# Altium schematic sheet GenPulseBox.SchDoc (part 2 of 2)
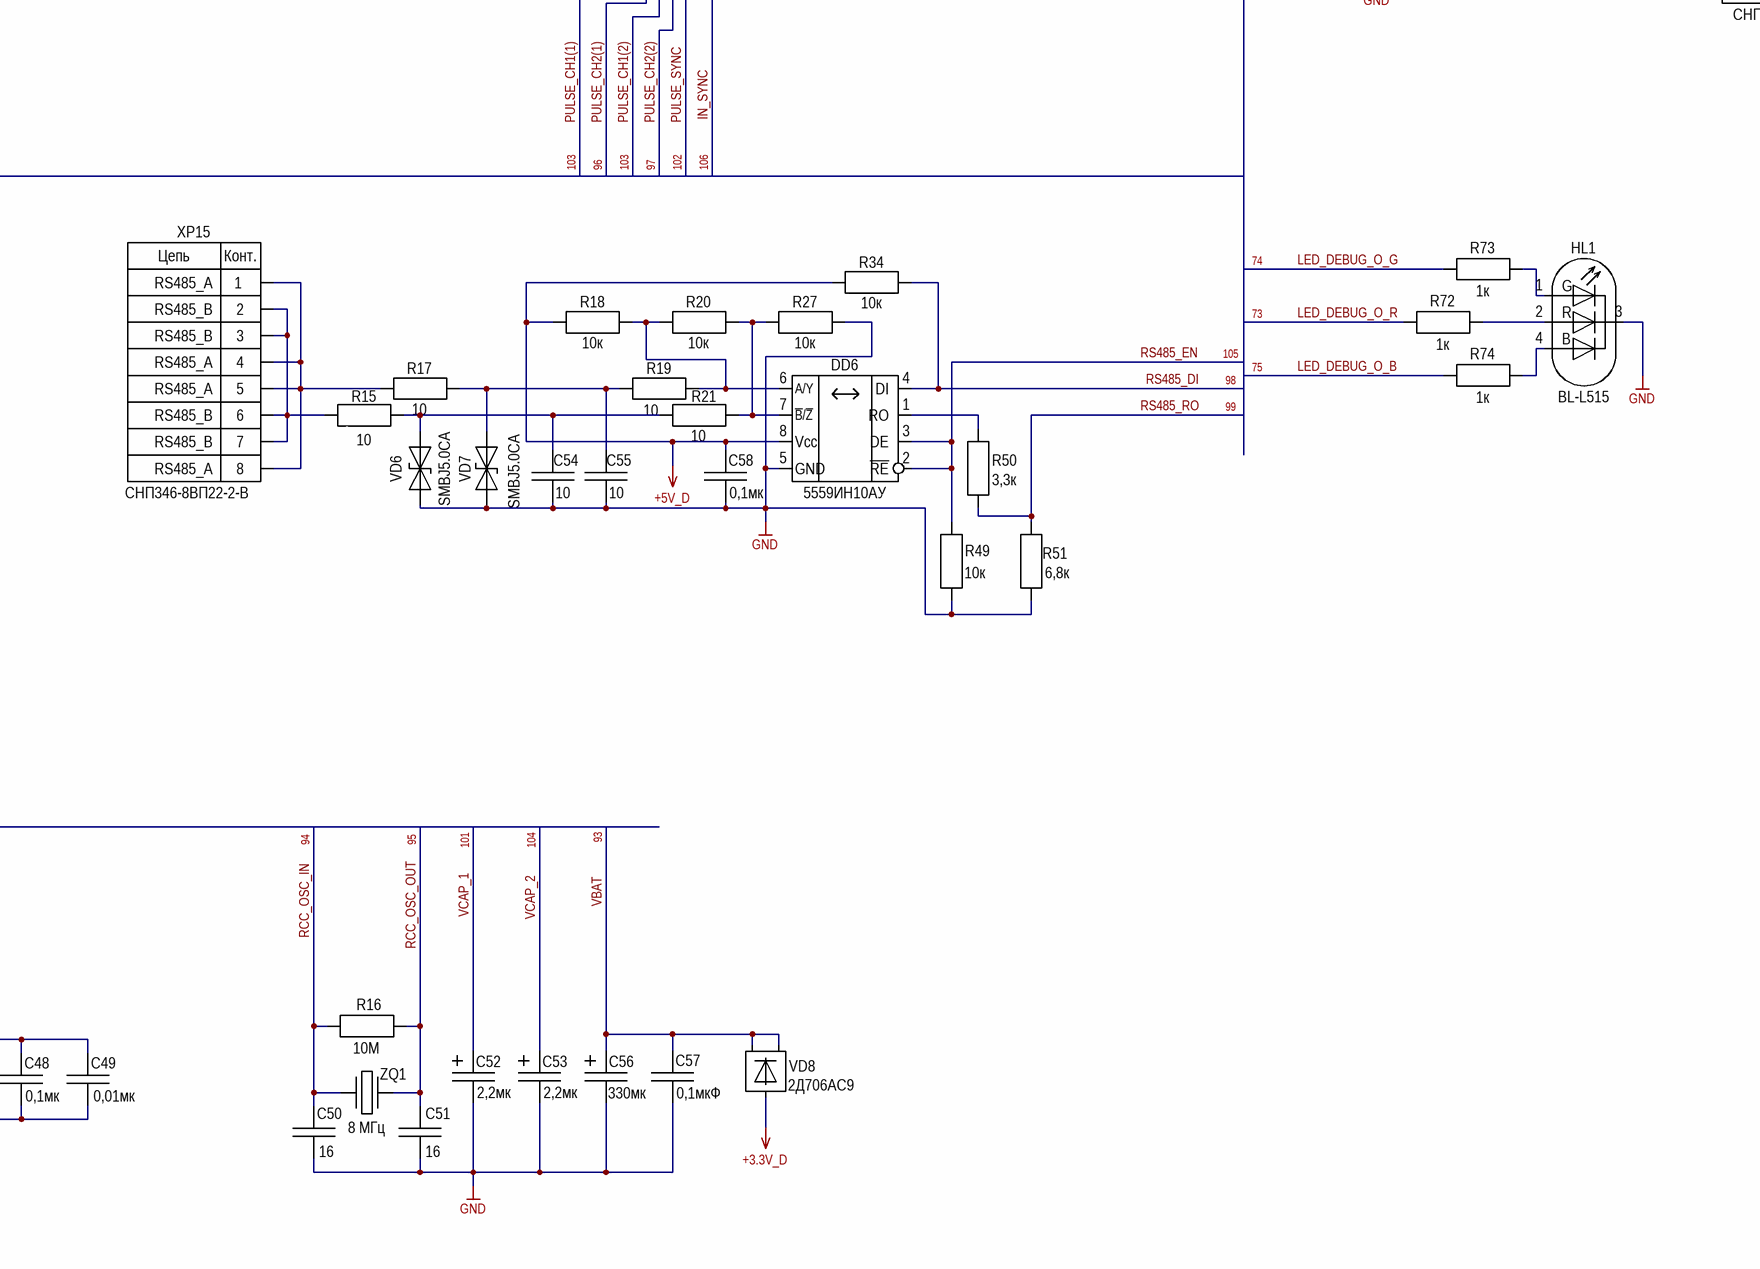
[diagram p4: GenPulseBox.SchDoc, bottom right]

## Library data of the parts
C1 C3 C7 C11 C13 C15 C17 C19 C21 C25 C33 C35 C36 = 2164: PartNumber: К53-56А-16 В-4,7 мкФ±20 %; Manufacturer: АО «НИИ ГИРИКОНД»; ManufacturerTU: АЖЯР.673546.001ТУ; Alternative: Case B 4,7 мкФ, 16 В, ±20 %; Alternative2: К53-56А-16 В-4,7 мкФ±20 % В АДПК.673546.005ТУ; Name: К53-56А; Group: Конденсаторы; ViewControl: В, 10%; SolderName: K53-56A-16V-4.7mkF; X_SORT_1: 100; X_SORT_2: 200; X_SORT_3: 1; SolderTemperature: 265; TemperatureRange: от минус 60 до 125; CardKRR: 67; VoltageLimit: 16; Key: 2164; MilitaryControl: ВП; MountType: ПМ; Modify: 13.03.2019; Package: K2 (Case B); ComponentLink1Description: К53-56А; ComponentLink1URL: \\192.168.0.253\U_Base\PDF\C\K53-56.pdf; HelpURL: \\192.168.0.253\U_Base\PDF\C\K53-56.pdf; DataSheet: #\\192.168.0.253\U_Base\PDF\C\К53-56А.pdf#
C2 C4 C8 C26 C34 C39-C48 C58 = 2161: PartNumber: К10-84в-2012М-50 В-Н90-0,1 мкФ+80 %-20 %-N-A; Manufacturer: ОАО «ВЗРД Монолит»; ManufacturerTU: ФЦТА.673516.016ТУ; Alternative: 0805 0,1 мкФ, 50 В, ±10 %; Name: К10-84в; Group: Конденсаторы; ViewControl: В, 10%; SolderName: K10-84v-2012M-50V-N90-0,1mkF; X_SORT_1: 100; X_SORT_2: 200; X_SORT_3: 1; SolderTemperature: 175; TemperatureRange: от минус 60 до 85; CardKRR: 67; Key: 2161; VoltageLimit: 50; MilitaryControl: ВП; MountType: ПМ; Modify: 13.03.2019; Package: 0805 (2012); ComponentLink1Description: К10-84; ComponentLink1URL: \\192.168.0.253\U_Base\PDF\C\K10-84.pdf; HelpURL: \\192.168.0.253\U_Base\PDF\C\K10-84.pdf; DataSheet: #\\192.168.0.253\U_Base\PDF\C\K10-84.pdf#
C5 C6 C30 = 2172: PartNumber: К53-56А-16 В-22 мкФ±20 %; Manufacturer: АО «НИИ ГИРИКОНД»; ManufacturerTU: АЖЯР.673546.001ТУ; Alternative: Case C 22 мкФ, 16 В, ±20 %; Alternative2: К53-56А-16 В-22 мкФ±20 % В АДПК.673546.005ТУ; Name: К53-56А; Group: Конденсаторы; ViewControl: В, 10%; SolderName: K53-56A-16V-22mkF; X_SORT_1: 100; X_SORT_2: 200; X_SORT_3: 1; SolderTemperature: 265; TemperatureRange: от минус 60 до 125; CardKRR: 67; VoltageLimit: 16; Key: 2172; MilitaryControl: ВП; MountType: ПМ; Modify: 13.03.2019; Package: K3 (Case С); ComponentLink1Description: К53-56А; ComponentLink1URL: \\192.168.0.253\U_Base\PDF\C\K53-56.pdf; HelpURL: \\192.168.0.253\U_Base\PDF\C\K53-56.pdf; DataSheet: #\\192.168.0.253\U_Base\PDF\C\К53-56А.pdf#
C9 C10 C23 C24 C31 C32 C37 C38 C57 C59-C61 = 2161: PartNumber: К10-84в-2012М-50 В-Н90-0,1 мкФ+80 %-20 %-N-A; Manufacturer: ОАО «ВЗРД Монолит»; ManufacturerTU: ФЦТА.673516.016ТУ; Alternative: 0805 0,1 мкФ, 50 В, ±10 %; Name: К10-84в; Group: Конденсаторы; ViewControl: В, 10%; SolderName: K10-84v-2012M-50V-N90-0,1mkF; X_SORT_1: 100; X_SORT_2: 200; X_SORT_3: 1; SolderTemperature: 175; TemperatureRange: от минус 60 до 85; CardKRR: 67; VoltageLimit: 50; Key: 2161; MilitaryControl: ВП; MountType: ПМ; Modify: 13.03.2019; Package: 0805 (2012); ComponentLink1Description: К10-84; ComponentLink1URL: \\192.168.0.253\U_Base\PDF\C\K10-84.pdf; HelpURL: \\192.168.0.253\U_Base\PDF\C\K10-84.pdf; DataSheet: #\\192.168.0.253\U_Base\PDF\C\K10-84.pdf#
C12 = 2164: Manufacturer: АО «НИИ ГИРИКОНД»; ManufacturerTU: АЖЯР.673546.001ТУ; PartNumber: К53-56А-16 В-4,7 мкФ±20 %; Alternative: Case B 4,7 мкФ, 16 В, ±20 %; Alternative2: К53-56А-16 В-4,7 мкФ±20 % В АДПК.673546.005ТУ; Name: К53-56А; Group: Конденсаторы; ViewControl: В, 10%; Key: 2164; SolderName: K53-56A-16V-4.7mkF; SolderTemperature: 265; TemperatureRange: от минус 60 до 125; CardKRR: 67; VoltageLimit: 16; X_SORT_1: 100; X_SORT_2: 200; X_SORT_3: 1; MilitaryControl: ВП; MountType: ПМ; Modify: 13.03.2019; Package: K2 (Case B); ComponentLink1Description: К53-56А; ComponentLink1URL: \\192.168.0.253\U_Base\PDF\C\K53-56.pdf; HelpURL: \\192.168.0.253\U_Base\PDF\C\K53-56.pdf; DataSheet: #\\192.168.0.253\U_Base\PDF\C\К53-56А.pdf#
C14 C16 C18 C20 C22 C52 C53 = 2166: PartNumber: К53-56А-25 В-2,2 мкФ±20 %; Manufacturer: АО «НИИ ГИРИКОНД»; ManufacturerTU: АЖЯР.673546.001ТУ; Alternative: Case B 2,2 мкФ, 25 В, ±20 %; Alternative2: К53-56А-25 В-2,2 мкФ±20 % В АДПК.673546.005ТУ; Name: К53-56А; Group: Конденсаторы; ViewControl: В, 10%; SolderName: K53-56A-25V-2.2mkF; X_SORT_1: 100; X_SORT_2: 200; X_SORT_3: 1; SolderTemperature: 265; TemperatureRange: от минус 60 до 125; CardKRR: 67; VoltageLimit: 25; Key: 2166; MilitaryControl: ВП; MountType: ПМ; Modify: 13.03.2019; Package: K2 (Case B); ComponentLink1Description: К53-56А; ComponentLink1URL: \\192.168.0.253\U_Base\PDF\C\K53-56.pdf; HelpURL: \\192.168.0.253\U_Base\PDF\C\K53-56.pdf; DataSheet: #\\192.168.0.253\U_Base\PDF\C\К53-56А.pdf#
C27-C29 C56 = 2249: PartNumber: К53-67-10 В-330 мкФ±10 %; Manufacturer: АО «НИИ ГИРИКОНД»; ManufacturerTU: АЖЯР.673546.006ТУ; Alternative: Case D 330 мкФ, 10 В, ±10 %; Name: К53-67; Group: Конденсаторы; ViewControl: В, 10%; SolderName: K53-67-10V-330mkF; X_SORT_1: 100; X_SORT_2: 200; X_SORT_3: 1; SolderTemperature: 265; TemperatureRange: от минус 60 до 125; CardKRR: 67; VoltageLimit: 32; Key: 2249; MilitaryControl: ВП; MountType: ПМ; Modify: 13.03.2019; Package: K3 (Case D); ComponentLink1Description: К53-67
C49 = 2796: PartNumber: К10-69в-Н90-50 В-2012М-0,01 мкФ+80/-20 %-N; Manufacturer: АО "НИИ "ГИРИКОНД"; ManufacturerTU: АЖЯР.673511.002ТУ; Alternative: 0805 0,01 мкФ, 50 В, ±10 %; Name: К10-69в; Group: Конденсаторы; ViewControl: В, 10%; SolderName: K10-69v-N90-50V-2012M-0.01mkF; X_SORT_1: 1; TemperatureRange: от минус 60 до 85; CardKRR: 67; Key: 2796; MilitaryControl: ВП; MountType: ПМ; Modify: 03.02.2020; X_SORT_2: 1; X_SORT_3: 1; ComponentLink1URL: \\192.168.0.253\U_Base\PDF\C\K10-69.pdf; HelpURL: \\192.168.0.253\U_Base\PDF\C\K10-69.pdf; DataSheet: \\192.168.0.253\U_Base\PDF\C\K10-69.pdf
C50 C51 = 2141: PartNumber: К10-84в-2012М-100 В-МП0-16 пФ±10 %-N-A; Manufacturer: ОАО «ВЗРД Монолит»; ManufacturerTU: ФЦТА.673516.016ТУ; Alternative: 0805 16 пФ, 100 В, ±10 %; Name: К10-84в; Group: Конденсаторы; ViewControl: В, 10%; SolderName: K10-84v-2012M-100V-MP0-16pF; X_SORT_1: 100; X_SORT_2: 200; X_SORT_3: 1; SolderTemperature: 175; TemperatureRange: от минус 60 до 85; CardKRR: 67; Key: 2141; MilitaryControl: ВП; MountType: ПМ; Modify: 13.03.2019; Package: 0805 (2012); ComponentLink1Description: К10-84; ComponentLink1URL: \\192.168.0.253\U_Base\PDF\C\K10-84.pdf; HelpURL: \\192.168.0.253\U_Base\PDF\C\K10-84.pdf; DataSheet: #\\192.168.0.253\U_Base\PDF\C\K10-84.pdf#; VoltageLimit: 100
C54 C55 C62-C67 = 2111: PartNumber: К10-84в-1608М-100 В-МП0-10 пФ±10 %-N-A; Manufacturer: ОАО «ВЗРД Монолит»; ManufacturerTU: ФЦТА.673516.016ТУ; Alternative: 0603 10 пФ, 100 В, ±10 %; Name: К10-84в; Group: Конденсаторы; ViewControl: В, 10%; SolderName: K10-84v-1608M-100V-MP0-10pF; X_SORT_1: 100; X_SORT_2: 200; X_SORT_3: 1; SolderTemperature: 175; TemperatureRange: от минус 60 до 85; CardKRR: 67; Key: 2111; MilitaryControl: ВП; MountType: ПМ; Modify: 13.03.2019; Package: 0603 (1608); ComponentLink1Description: К10-84; ComponentLink1URL: \\192.168.0.253\U_Base\PDF\C\K10-84.pdf; HelpURL: \\192.168.0.253\U_Base\PDF\C\K10-84.pdf; DataSheet: #\\192.168.0.253\U_Base\PDF\C\K10-84.pdf#; VoltageLimit: 100
DA1 = 112: Manufacturer: Texas Instruments; Group: Микросхемы; CardKRR: 64; Name: LM2937IMP-3.3/NOPB; ViewControl: В, 100%; key: 112; TemperatureRange: от минус 40 до 125; VoltageLimit: 26; X_SORT_1: 200; X_SORT_2: 401; X_SORT_3: 1; MilitaryControl: ОТК; MountType: ПМ; Modify: 12.11.2020; PartNumber: LM2937IMP-3.3/NOPB; SolderName: LM2937IMP-3.3/NOPB
DA2 DA3 = 71: Notice: Analog Devices; Group: Микросхемы; CardKRR: 63; Name: AD8044ARZ-14; ViewControl: В, 100%; key: 71; TemperatureRange: от минус 40 до 85; X_SORT_1: 200; X_SORT_2: 401; X_SORT_3: 1; Manufacturer: Analog Devices; HelpURL: \\192.168.0.253\U_Base\PDF\D\AD8044.pdf; MilitaryControl: ОТК; MountType: ПМ; Modify: 14.03.2019; PartNumber: AD8044ARZ-14; SolderName: AD8044ARZ-14; Package: SOIC14; ComponentLink1URL: \\192.168.0.253\U_Base\PDF\D\AD8044.pdf; DataSheet: #\\192.168.0.253\U_Base\PDF\D\AD8044.pdf#
DD1-DD3 DD5 = 4: Manufacturer: ОАО «ИНТЕГРАЛ»; ManufacturerTU: бК0.347.364-01ТУ; Group: Микросхемы; CardKRR: 65; CurrentLimit: 0,0038; Name: 1533ЛН1; ViewControl: В, 100%; key: 4; TemperatureRange: от минус 60 до 125; X_SORT_1: 200; X_SORT_2: 400; X_SORT_3: 1; HelpURL: \\192.168.0.101\U_Base\PDF\D\1533ЛН1.pdf; MilitaryControl: ВП; MountType: РМ; Modify: 14.03.2019; PartNumber: 1533ЛН1; SolderName: 1533LN1; Package: 401.14-5; ComponentLink1URL: \\192.168.0.101\U_Base\PDF\D\1533ЛН1.pdf; DataSheet: #\\192.168.0.101\U_Base\PDF\D\1533ЛН1.pdf#
DD4 = 109: Manufacturer: STMicroelectronics; Group: Микросхемы; CardKRR: 64б; ViewControl: В, 100%; X_SORT_1: 201; X_SORT_2: 401; X_SORT_3: A; TemperatureRange: от минус 40 до 85; key: 109; PartNumber: STM32F407IGT6; HelpURL: \\192.168.0.253\U_Base\PDF\D\STM32F407IGT6 LQFP176.pdf; Name: STM32F407IGT6; MilitaryControl: ОТК; MountType: ПМ; Modify: 15.03.2021; SolderName: STM32F407IGT6; ComponentLink1URL: \\192.168.0.253\U_Base\PDF\D\STM32F407IGT6 LQFP176.pdf; DataSheet: #\\192.168.0.253\U_Base\PDF\D\STM32F407IGT6 LQFP176.pdf#
DD6 = 53: PartNumber: 5559ИН10АУ; Manufacturer: АО «ПКК МИЛАНДР»; ManufacturerTU: АЕЯР.431230.645ТУ; SolderName: 5559IN10AU; Group: Микросхемы; Alternative: К5559ИН10АУ ТСКЯ.431323.002СП; TemperatureRange: от минус 60 до 125; key: 53; Alternative2: MAX13085EESA+T; CardKRR: 65; CurrentLimit: 0,25; ViewControl: В, 100%; X_SORT_1: 200; X_SORT_2: 400; X_SORT_3: 1; Name: 5559ИН10АУ; ComponentLink1URL: \\192.168.0.253\U_Base\PDF\D\5559ИН10АУ.pdf; HelpURL: \\192.168.0.253\U_Base\PDF\D\5559ИН10АУ.pdf; DataSheet: #\\192.168.0.253\U_Base\PDF\D\5559ИН10АУ.pdf#; MilitaryControl: ВП; MountType: РМ; Modify: 27.03.2019; Package: H02.8-1B
FU1 FU3 FU5-FU8 = 65: Manufacturer: Bourns; PartNumber: Предохранитель MF-R050, 0.5 A; Name: MF-R050, 0.5 A; Group: Предохранитель; ViewControl: В,100%; Key: 65; SolderName: MF-R050,0.5A; Mass: 0,1; TemperatureRange: от минус 40 до 85; CardKRR: 87; MilitaryControl: ОТК; MountType: РМ; Modify: 05.12.2022; ComponentLink1URL: \\192.168.0.101\U_Base\PDF\OTHER\MF-Rxxx.pdf; HelpURL: \\192.168.0.101\U_Base\PDF\OTHER\MF-Rxxx.pdf; DataSheet: #\\192.168.0.101\U_Base\PDF\OTHER\MF-Rxxx.pdf#
FU2 FU4 = 67: Manufacturer: Bourns; PartNumber: Предохранитель MF-R185, 1.85 A; Name: MF-R185, 1.85 A; Group: Предохранитель; ViewControl: В,100%; Key: 67; SolderName: MF-R185,1.85A; Mass: 0,1; TemperatureRange: от минус 40 до 85; CardKRR: 87; MilitaryControl: ОТК; MountType: РМ; Modify: 05.12.2022; ComponentLink1URL: \\192.168.0.101\U_Base\PDF\OTHER\MF-Rxxx.pdf; HelpURL: \\192.168.0.101\U_Base\PDF\OTHER\MF-Rxxx.pdf; DataSheet: #\\192.168.0.101\U_Base\PDF\OTHER\MF-Rxxx.pdf#
HL1 = 90: Светодиод RGB с общим анодом BL-L515RGBW-CA; PartNumber: Светодиод BL-L515RGBW-CС; Notice: Betlux Electronics; Group: Светодиоды; ViewControl: В, 10%; key: 90; X_SORT_1: 500; X_SORT_2: 301; X_SORT_3: 1; Name: BL-L515; Modify: 14.03.2019; Manufacturer: Betlux Electronics; MilitaryControl: ОТК; MountType: РМ; SolderName: BL-L515; Package: 6mm; ComponentLink1Description: BL-L515; ComponentLink1URL: \\192.168.0.101\U_Base\PDF\V\BetLux Electronics.pdf; HelpURL: \\192.168.0.101\U_Base\PDF\V\BetLux Electronics.pdf; DataSheet: #\\192.168.0.101\U_Base\PDF\V\BetLux Electronics.pdf#
KT1-KT4 = 4: PartNumber: Контакт; SolderName: Kontakt; Key: 4
L1-L4 = 4177: PartNumber: BLM31PG601SH1; Notice: Murata; Group: Индуктивности; ViewControl: В, 10%; X_SORT_1: 300; X_SORT_2: 701; X_SORT_3: 1; Mass: 0,025; TemperatureRange: от минус 55 до 125; CardKRR: 86; CurrentLimit: 1,5; Key: 4177; Name: BLM31PG601SH1; Manufacturer: Murata; MilitaryControl: ОТК; MountType: ПМ; Modify: 20.02.2019; SolderName: BLM31PG601SH1; Package: 1206 (3216); ComponentLink1URL: \\192.168.0.253\U_Base\PDF\L\BLM31PG.pdf; HelpURL: \\192.168.0.253\U_Base\PDF\L\BLM31PG.pdf; DataSheet: #\\192.168.0.253\U_Base\PDF\L\BLM31PG.pdf#
R1 = 2960: Manufacturer: АО «НПО «Эркон»; ManufacturerTU: ОЖ0.467.164ТУ; PartNumber: Р1-8В-0,125-1,5 кОм±5 %-Т-А; Alternative: 0805 1,5 кОм, 0,125 Вт, ±5 %; Alternative2: Р1-8В-0,125-1,5 кОм±5 %-Т-А ОЖ0.467.164ТУ; Name: Р1-8В; Group: Резисторы; ViewControl: В, 10%; key: 2960; SolderName: R1-8B-0.125-1.5kOm; Mark: 152; Mass: 0,006; SolderTemperature: 255; TemperatureRange: от минус 65 до 155; CardKRR: 68; VoltageLimit: 150; PowerLimit: 0,125; X_SORT_1: 400; X_SORT_2: 100; X_SORT_3: 1; Modify: 28.06.2019; MilitaryControl: ВП; MountType: ПМ; Package: 0805 (2012); ComponentLink1Description: Р1-8В; ComponentLink1URL: \\192.168.0.101\U_Base\PDF\R\Р1-8В.pdf; HelpURL: \\192.168.0.101\U_Base\PDF\R\Р1-8В.pdf; DataSheet: #\\192.168.0.101\U_Base\PDF\R\Р1-8В.pdf#
R2 = 2965: Manufacturer: АО «НПО «Эркон»; ManufacturerTU: ОЖ0.467.164ТУ; PartNumber: Р1-8В-0,125-100 кОм±5 %-Т-А; Alternative: 0805 100 кОм, 0,125 Вт, ±5 %; Alternative2: Р1-8В-0,125-100 кОм±5 %-Т-А ОЖ0.467.164ТУ; Name: Р1-8В; Group: Резисторы; ViewControl: В, 10%; key: 2965; SolderName: R1-8B-0.125-100kOm; Mark: 104; Mass: 0,006; SolderTemperature: 255; TemperatureRange: от минус 65 до 155; CardKRR: 68; VoltageLimit: 150; PowerLimit: 0,125; X_SORT_1: 400; X_SORT_2: 100; X_SORT_3: 1; Modify: 28.06.2019; MilitaryControl: ВП; MountType: ПМ; Package: 0805 (2012); ComponentLink1Description: Р1-8В; ComponentLink1URL: \\192.168.0.101\U_Base\PDF\R\Р1-8В.pdf; HelpURL: \\192.168.0.101\U_Base\PDF\R\Р1-8В.pdf; DataSheet: #\\192.168.0.101\U_Base\PDF\R\Р1-8В.pdf#
R3 R4 R12 R14 = 3037: PartNumber: Р1-8В-0,25-100 Ом±5 %-Т-А; Manufacturer: АО «НПО «Эркон»; ManufacturerTU: ОЖ0.467.164ТУ; Alternative: 1206 100 Ом, 0,25 Вт, ±5 %; Alternative2: Р1-8В-0,25-100 Ом±5 %-Т-А ОЖ0.467.164ТУ; Name: Р1-8В; Group: Резисторы; ViewControl: В, 10%; SolderName: R1-8B-0.25-100Om; Mark: 101; X_SORT_1: 400; X_SORT_3: 1; Mass: 0,01; SolderTemperature: 255; TemperatureRange: от минус 65 до 155; CardKRR: 68; VoltageLimit: 200; PowerLimit: 0,25; key: 3037; Modify: 28.06.2019; MilitaryControl: ВП; MountType: ПМ; X_SORT_2: 100; Package: 1206 (3216); ComponentLink1Description: Р1-8В; ComponentLink1URL: \\192.168.0.253\U_Base\PDF\R\Р1-8В.pdf; HelpURL: \\192.168.0.253\U_Base\PDF\R\Р1-8В.pdf; DataSheet: \\192.168.0.253\U_Base\PDF\R\Р1-8В.pdf
R5-R11 = 2905: PartNumber: Р1-8В-0,063-10 кОм±5 %-Т-А; Manufacturer: АО «НПО «Эркон»; ManufacturerTU: ОЖ0.467.164ТУ; Alternative: 0402 10 кОм, 0,062 Вт, ±5 %; Alternative2: Р1-8В-0,062-10 кОм±5 %-Т-А ОЖ0.467.164ТУ; Name: Р1-8В; Group: Резисторы; ViewControl: В, 10%; SolderName: R1-8B-0.063-10kOm; Mark: 103; X_SORT_1: 400; X_SORT_2: 100; X_SORT_3: 1; Mass: 0,0007; SolderTemperature: 255; TemperatureRange: от минус 65 до 155; CardKRR: 68; VoltageLimit: 50; PowerLimit: 0,063; key: 2905; Modify: 28.06.2019; MilitaryControl: ВП; MountType: ПМ; Package: 0402 (1005); ComponentLink1Description: Р1-8В; ComponentLink1URL: \\192.168.0.253\U_Base\PDF\R\Р1-8В.pdf; HelpURL: \\192.168.0.253\U_Base\PDF\R\Р1-8В.pdf; DataSheet: #\\192.168.0.253\U_Base\PDF\R\Р1-8В.pdf#
R13 = 3121: PartNumber: Р1-8В-1,0-0,15 Ом±20 %-А; Manufacturer: АО «НПО «Эркон»; ManufacturerTU: ОЖ0.467.164ТУ; Alternative: 2512 0,15 Ом, 1 Вт, ±5 %; Alternative2: Р1-8В-1,0-0,15 Ом±20 %-А ОЖ0.467.164ТУ; Name: Р1-8В; Group: Резисторы; ViewControl: В, 10%; SolderName: R1-8B-1.0-0.15Om; Mark: 0R15; X_SORT_1: 400; X_SORT_2: 100; X_SORT_3: 1; Mass: 0,04; SolderTemperature: 255; TemperatureRange: от минус 65 до 155; CardKRR: 68; VoltageLimit: 200; key: 3121; Modify: 28.06.2019; MilitaryControl: ВП; MountType: ПМ; Package: 2512 (6432); ComponentLink1Description: Р1-8В; ComponentLink1URL: \\192.168.0.253\U_Base\PDF\R\Р1-8В.pdf; HelpURL: \\192.168.0.253\U_Base\PDF\R\Р1-8В.pdf; DataSheet: \\192.168.0.253\U_Base\PDF\R\Р1-8В.pdf; PowerLimit: 1
R15 R17 R19 R21 = 2944: Manufacturer: АО «НПО «Эркон»; ManufacturerTU: ОЖ0.467.164ТУ; PartNumber: Р1-8В-0,1-10 Ом±5 %-Т-А; Alternative: 0603 10 Ом, 0,1 Вт, ±5 %; Alternative2: Р1-8В-0,1-10 Ом±5 %-Т-А ОЖ0.467.164ТУ; Name: Р1-8В; Group: Резисторы; ViewControl: В, 10%; key: 2944; SolderName: R1-8B-0.1-10Om; Mark: 100; Mass: 0,002; SolderTemperature: 255; TemperatureRange: от минус 65 до 155; CardKRR: 68; PowerLimit: 0,1; X_SORT_1: 400; X_SORT_3: 1; Modify: 28.06.2019; MilitaryControl: ВП; MountType: ПМ; Package: 0603 (1608); ComponentLink1Description: Р1-8В; ComponentLink1URL: \\192.168.0.253\U_Base\PDF\R\Р1-8В.pdf; HelpURL: \\192.168.0.253\U_Base\PDF\R\Р1-8В.pdf; DataSheet: \\192.168.0.253\U_Base\PDF\R\Р1-8В.pdf; VoltageLimit: 100; X_SORT_2: 100
R16 R22-R26 = 32904893: PartNumber: Р1-8В-0,125-10 МОм±5 %-Т-А; Manufacturer: АО «НПО «Эркон»; ManufacturerTU: ОЖ0.467.164ТУ; Alternative: 0805 10 МОм, 0,125 Вт, ±5 %; Name: Р1-8В; Group: Резисторы; ViewControl: В, 10%; SolderName: R1-8B-0.125-10MOm; X_SORT_1: 400; X_SORT_2: 100; X_SORT_3: 1; SolderTemperature: 255; TemperatureRange: от минус 65 до 155; CardKRR: 68; VoltageLimit: 150; PowerLimit: 0,125; Modify: 28.06.2019; MilitaryControl: ВП; MountType: ПМ; ComponentLink1Description: Р1-8В; ComponentLink1URL: \\192.168.0.253\U_Base\PDF\R\Р1-8В.pdf; HelpURL: \\192.168.0.253\U_Base\PDF\R\Р1-8В.pdf; DataSheet: \\192.168.0.253\U_Base\PDF\R\Р1-8В.pdf; key: 32904893
R18 R20 R27 R28 R34 R40-R42 R49 R57-R59 = 2943: Manufacturer: АО «НПО «Эркон»; ManufacturerTU: ОЖ0.467.164ТУ; PartNumber: Р1-8В-0,1-10 кОм±5 %-Т-А; Alternative: 0603 10 кОм, 0,1 Вт, ±5 %; Alternative2: Р1-8В-0,1-10 кОм±5 %-Т-А ОЖ0.467.164ТУ; Name: Р1-8В; Group: Резисторы; ViewControl: В, 10%; key: 2943; SolderName: R1-8B-0.1-10kOm; Mark: 103; Mass: 0,002; SolderTemperature: 255; TemperatureRange: от минус 65 до 155; CardKRR: 68; VoltageLimit: 100; PowerLimit: 0,1; X_SORT_1: 400; X_SORT_3: 1; Modify: 28.06.2019; MilitaryControl: ВП; MountType: ПМ; Package: 0603 (1608); ComponentLink1Description: Р1-8В; ComponentLink1URL: \\192.168.0.253\U_Base\PDF\R\Р1-8В.pdf; HelpURL: \\192.168.0.253\U_Base\PDF\R\Р1-8В.pdf; DataSheet: \\192.168.0.253\U_Base\PDF\R\Р1-8В.pdf; X_SORT_2: 100
R29-R33 R35-R39 R72-R74 = 2957: Manufacturer: АО «НПО «Эркон»; ManufacturerTU: ОЖ0.467.164ТУ; PartNumber: Р1-8В-0,125-1 кОм±5 %-Т-А; Alternative: 0805 1 кОм, 0,125 Вт, ±5 %; Alternative2: Р1-8В-0,125-1 кОм±5 %-Т-А ОЖ0.467.164ТУ; Name: Р1-8В; Group: Резисторы; ViewControl: В, 10%; key: 2957; SolderName: R1-8B-0.125-1kOm; Mark: 102; Mass: 0,006; SolderTemperature: 255; TemperatureRange: от минус 65 до 155; CardKRR: 68; VoltageLimit: 150; PowerLimit: 0,125; X_SORT_1: 400; X_SORT_2: 100; X_SORT_3: 1; Modify: 28.06.2019; MilitaryControl: ВП; MountType: ПМ; Package: 0805 (2012); ComponentLink1Description: Р1-8В; ComponentLink1URL: \\192.168.0.253\U_Base\PDF\R\Р1-8В.pdf; HelpURL: \\192.168.0.253\U_Base\PDF\R\Р1-8В.pdf; DataSheet: \\192.168.0.253\U_Base\PDF\R\Р1-8В.pdf
R43 = 2978: Manufacturer: АО «НПО «Эркон»; ManufacturerTU: ОЖ0.467.164ТУ; PartNumber: Р1-8В-0,125-220 кОм±5 %-Т-А; Alternative: 0805 220 кОм, 0,125 Вт, ±5 %; Alternative2: Р1-8В-0,125-220 кОм±5 %-Т-А ОЖ0.467.164ТУ; Name: Р1-8В; Group: Резисторы; ViewControl: В, 10%; key: 2978; SolderName: R1-8B-0.125-220kOm; Mark: 224; Mass: 0,006; SolderTemperature: 255; TemperatureRange: от минус 65 до 155; CardKRR: 68; VoltageLimit: 150; PowerLimit: 0,125; X_SORT_1: 400; X_SORT_2: 100; X_SORT_3: 1; Modify: 28.06.2019; MilitaryControl: ВП; MountType: ПМ; Package: 0805 (2012); ComponentLink1Description: Р1-8В; ComponentLink1URL: \\192.168.0.101\U_Base\PDF\R\Р1-8В.pdf; HelpURL: \\192.168.0.101\U_Base\PDF\R\Р1-8В.pdf; DataSheet: #\\192.168.0.101\U_Base\PDF\R\Р1-8В.pdf#
R44-R48 = 2941: Manufacturer: АО «НПО «Эркон»; ManufacturerTU: ОЖ0.467.164ТУ; PartNumber: Р1-8В-0,1-1,5 кОм±5 %-Т-А; Alternative: 0603 1,5 кОм, 0,1 Вт, ±5 %; Alternative2: Р1-8В-0,1-1,5 кОм±5 %-Т-А ОЖ0.467.164ТУ; Name: Р1-8В; Group: Резисторы; ViewControl: В, 10%; key: 2941; SolderName: R1-8B-0.1-1.5kOm; Mark: 152; Mass: 0,002; SolderTemperature: 255; TemperatureRange: от минус 65 до 155; CardKRR: 68; VoltageLimit: 100; PowerLimit: 0,1; X_SORT_1: 400; X_SORT_3: 1; Modify: 28.06.2019; MilitaryControl: ВП; MountType: ПМ; Package: 0603 (1608); ComponentLink1Description: Р1-8В; ComponentLink1URL: \\192.168.0.101\U_Base\PDF\R\Р1-8В.pdf; HelpURL: \\192.168.0.101\U_Base\PDF\R\Р1-8В.pdf; DataSheet: #\\192.168.0.101\U_Base\PDF\R\Р1-8В.pdf#; X_SORT_2: 100
R50 = 3011: Manufacturer: АО «НПО «Эркон»; ManufacturerTU: ОЖ0.467.164ТУ; PartNumber: Р1-8В-0,1-3,3 кОм±5 %-Т-А; Alternative: 0603 3,3 кОм, 0,1 Вт, ±5 %; Alternative2: Р1-8В-0,1-3,3 кОм±5 %-Т-А ОЖ0.467.164ТУ; Name: Р1-8В; Group: Резисторы; ViewControl: В, 10%; key: 3011; SolderName: R1-8B-0.1-3.3kOm; Mark: 332; Mass: 0,002; SolderTemperature: 255; TemperatureRange: от минус 65 до 155; CardKRR: 68; VoltageLimit: 100; PowerLimit: 0,1; X_SORT_1: 400; X_SORT_3: 1; Modify: 28.06.2019; MilitaryControl: ВП; MountType: ПМ; Package: 0603 (1608); ComponentLink1Description: Р1-8В; ComponentLink1URL: \\192.168.0.253\U_Base\PDF\R\Р1-8В.pdf; HelpURL: \\192.168.0.253\U_Base\PDF\R\Р1-8В.pdf; DataSheet: \\192.168.0.253\U_Base\PDF\R\Р1-8В.pdf; X_SORT_2: 100
R51 = 3024: Manufacturer: АО «НПО «Эркон»; ManufacturerTU: ОЖ0.467.164ТУ; PartNumber: Р1-8В-0,1-6,8 кОм±5 %-Т-А; Alternative: 0603 6,8 кОм, 0,1 Вт, ±5 %; Alternative2: Р1-8В-0,1-6,8 кОм±5 %-Т-А ОЖ0.467.164ТУ; Name: Р1-8В; Group: Резисторы; ViewControl: В, 10%; key: 3024; SolderName: R1-8B-0.1-6.8kOm; Mark: 682; Mass: 0,002; SolderTemperature: 255; TemperatureRange: от минус 65 до 155; CardKRR: 68; VoltageLimit: 100; PowerLimit: 0,1; X_SORT_1: 400; X_SORT_3: 1; Modify: 28.06.2019; MilitaryControl: ВП; MountType: ПМ; Package: 0603 (1608); ComponentLink1Description: Р1-8В; ComponentLink1URL: \\192.168.0.253\U_Base\PDF\R\Р1-8В.pdf; HelpURL: \\192.168.0.253\U_Base\PDF\R\Р1-8В.pdf; DataSheet: \\192.168.0.253\U_Base\PDF\R\Р1-8В.pdf; X_SORT_2: 100
R52-R56 = 3017: Manufacturer: АО «НПО «Эркон»; ManufacturerTU: ОЖ0.467.164ТУ; PartNumber: Р1-8В-0,1-4,7 кОм±5 %-Т-А; Alternative: 0603 4,7 кОм, 0,1 Вт, ±5 %; Alternative2: Р1-8В-0,1-4,7 кОм±5 %-Т-А ОЖ0.467.164ТУ; Name: Р1-8В; Group: Резисторы; ViewControl: В, 10%; key: 3017; SolderName: R1-8B-0.1-4.7kOm; Mark: 472; Mass: 0,002; SolderTemperature: 255; TemperatureRange: от минус 65 до 155; CardKRR: 68; VoltageLimit: 100; PowerLimit: 0,1; X_SORT_1: 400; X_SORT_3: 1; Modify: 28.06.2019; MilitaryControl: ВП; MountType: ПМ; Package: 0603 (1608); ComponentLink1Description: Р1-8В; ComponentLink1URL: \\192.168.0.101\U_Base\PDF\R\Р1-8В.pdf; HelpURL: \\192.168.0.101\U_Base\PDF\R\Р1-8В.pdf; DataSheet: #\\192.168.0.101\U_Base\PDF\R\Р1-8В.pdf#; X_SORT_2: 100
R60-R69 R75-R84 = 3137: Manufacturer: АО «НПО «Эркон»; ManufacturerTU: ОЖ0.467.164ТУ; PartNumber: Р1-8В-1,0-22 Ом±5 %-Т-А; Alternative: 2512 22 Ом, 1 Вт, ±5 %; Alternative2: Р1-8В-1,0-22 Ом±5 %-Т-А ОЖ0.467.164ТУ; Name: Р1-8В; Group: Резисторы; ViewControl: В, 10%; key: 3137; SolderName: R1-8B-1.0-22Om; Mark: 220; Mass: 0,04; SolderTemperature: 255; TemperatureRange: от минус 65 до 155; CardKRR: 68; VoltageLimit: 200; PowerLimit: 1; X_SORT_1: 400; X_SORT_2: 100; Modify: 28.06.2019; MilitaryControl: ВП; MountType: ПМ; Package: 2512 (6432); ComponentLink1Description: Р1-8В; ComponentLink1URL: \\192.168.0.101\U_Base\PDF\R\Р1-8В.pdf; HelpURL: \\192.168.0.101\U_Base\PDF\R\Р1-8В.pdf; DataSheet: #\\192.168.0.101\U_Base\PDF\R\Р1-8В.pdf#; X_SORT_3: 1
R70 R71 = 3121: Manufacturer: АО «НПО «Эркон»; ManufacturerTU: ОЖ0.467.164ТУ; PartNumber: Р1-8В-1,0-0,15 Ом±20 %-А; Alternative: 2512 0,15 Ом, 1 Вт, ±5 %; Alternative2: Р1-8В-1,0-0,15 Ом±20 %-А ОЖ0.467.164ТУ; Name: Р1-8В; Group: Резисторы; ViewControl: В, 10%; key: 3121; SolderName: R1-8B-1.0-0.15Om; Mark: 0R15; Mass: 0,04; SolderTemperature: 255; TemperatureRange: от минус 65 до 155; CardKRR: 68; VoltageLimit: 200; PowerLimit: 1; X_SORT_1: 400; X_SORT_2: 100; Modify: 28.06.2019; MilitaryControl: ВП; MountType: ПМ; Package: 2512 (6432); ComponentLink1Description: Р1-8В; ComponentLink1URL: \\192.168.0.101\U_Base\PDF\R\Р1-8В.pdf; HelpURL: \\192.168.0.101\U_Base\PDF\R\Р1-8В.pdf; DataSheet: #\\192.168.0.101\U_Base\PDF\R\Р1-8В.pdf#; X_SORT_3: 1
VD1-VD7 VD9-VD14 = 163: Manufacturer: STMicroelectronics; PartNumber: Диод защитный SMBJ5.0CA-TR; Alternative: SMBJ5.0CA-TR YJ; Value: SMBJ5.0CA; Group: Диоды; ViewControl: В, 10%; key: 163; Mass: 0.26; SolderTemperature: 260; TemperatureRange: от минус 55 до 150; CardKRR: 56; VoltageLimit: 13,4; Modify: 05.12.2022; MilitaryControl: ОТК; MountType: ПМ; SolderName: SMBJ5.0CA; ComponentLink1URL: \\192.168.0.101\U_Base\PDF\V\SMBJ.pdf; HelpURL: \\192.168.0.101\U_Base\PDF\V\SMBJ.pdf; DataSheet: #\\192.168.0.101\U_Base\PDF\V\SMBJ.pdf#
VD8 = 15: PartNumber: Набор диодов 2Д706АС9; Manufacturer: ООО «Крип Техно»; ManufacturerTU: аА0.339.582ТУ; Alternative: КД706АС9 аА0.336.543ТУ; Alternative2: BAW56LT1G; Group: Диоды; ViewControl: В, 10%; key: 15; SolderName: 2D706AS9; X_SORT_1: 500; X_SORT_2: 300; X_SORT_3: 1; Mass: 0,009; TemperatureRange: от минус 60 до 125; CardKRR: 55; Modify: 14.03.2019; MilitaryControl: ВП; MountType: ПМ; Package: SOT23; ComponentLink1Description: 2Д706АС9; ComponentLink1URL: \\192.168.0.253\U_Base\PDF\V\2Д706АС9.pdf; HelpURL: \\192.168.0.253\U_Base\PDF\V\2Д706АС9.pdf; DataSheet: #\\192.168.0.253\U_Base\PDF\V\2Д706АС9.pdf#
XP1 = 57: Manufacturer: АО «Карачевский завод Электродеталь»; ManufacturerTU: РЮМК.430420.011ТУ; PartNumber: Вилка СНП346-34ВП22-2-В; Conn35Name: 35; Conn36Name: 36; Conn37Name: 37; Conn38Name: 38; Conn39Name: 39; Conn40Name: 40; Conn01Name: GND; Conn02Name: 5V; Conn03Name: D1; Conn04Name: D0; Conn05Name: D3; Conn06Name: D2; Conn07Name: D5; Conn08Name: D4; Conn09Name: D7; Conn10Name: D6; Conn11Name: D9; Conn12Name: D8; Conn13Name: D11; Conn14Name: D10; Conn15Name: D13; Conn16Name: D12; Conn17Name: D15; Conn18Name: D14; Conn19Name: RS; Conn21Name: RD; Conn22Name: WR; Conn20Name: LCD-CS; Conn23Name: NC; Conn24Name: RST; Conn26Name: BL-VCC; Conn27Name: TP-IRQ; Conn28Name: BL-CTRL; Conn29Name: TP-SCK; Conn30Name: TP-CS; Conn31Name: TP-SDO; Conn32Name: TP-SDI; Conn34Name: 3V3; Alternative2: СНП346-34ВП22-2 РЮМК.430420.019ТУ; Name: СНП346-34ВП22-2-В; Value: 34; Group: Соединители; ViewControl: В, 10%; key: 57; SolderName: SNP346-34VP22-2; Mass: 0,00204; TemperatureRange: от минус 60 до 85; CardKRR: 75; VoltageLimit: 250; CurrentLimit: 1; X_SORT_1: 700; X_SORT_2: 600; Conn25Name: GND; Conn33Name: GND; Alternative: PLD-34; MilitaryControl: ВП; MountType: РМ; Modify: 19.09.2018; Package: PLD; ComponentLink1Description: СНП346; ComponentLink1URL: \\192.168.0.101\U_Base\PDF\X\СНП346.pdf; HelpURL: \\192.168.0.101\U_Base\PDF\X\СНП346.pdf; DataSheet: #\\192.168.0.101\U_Base\PDF\X\СНП346.pdf#; PowerLimit: 250; X_SORT_3: 1